# EasyEDA Pro project ProProject_Avaota Pi A_2024-03-25.epro, board 点位 (continued)
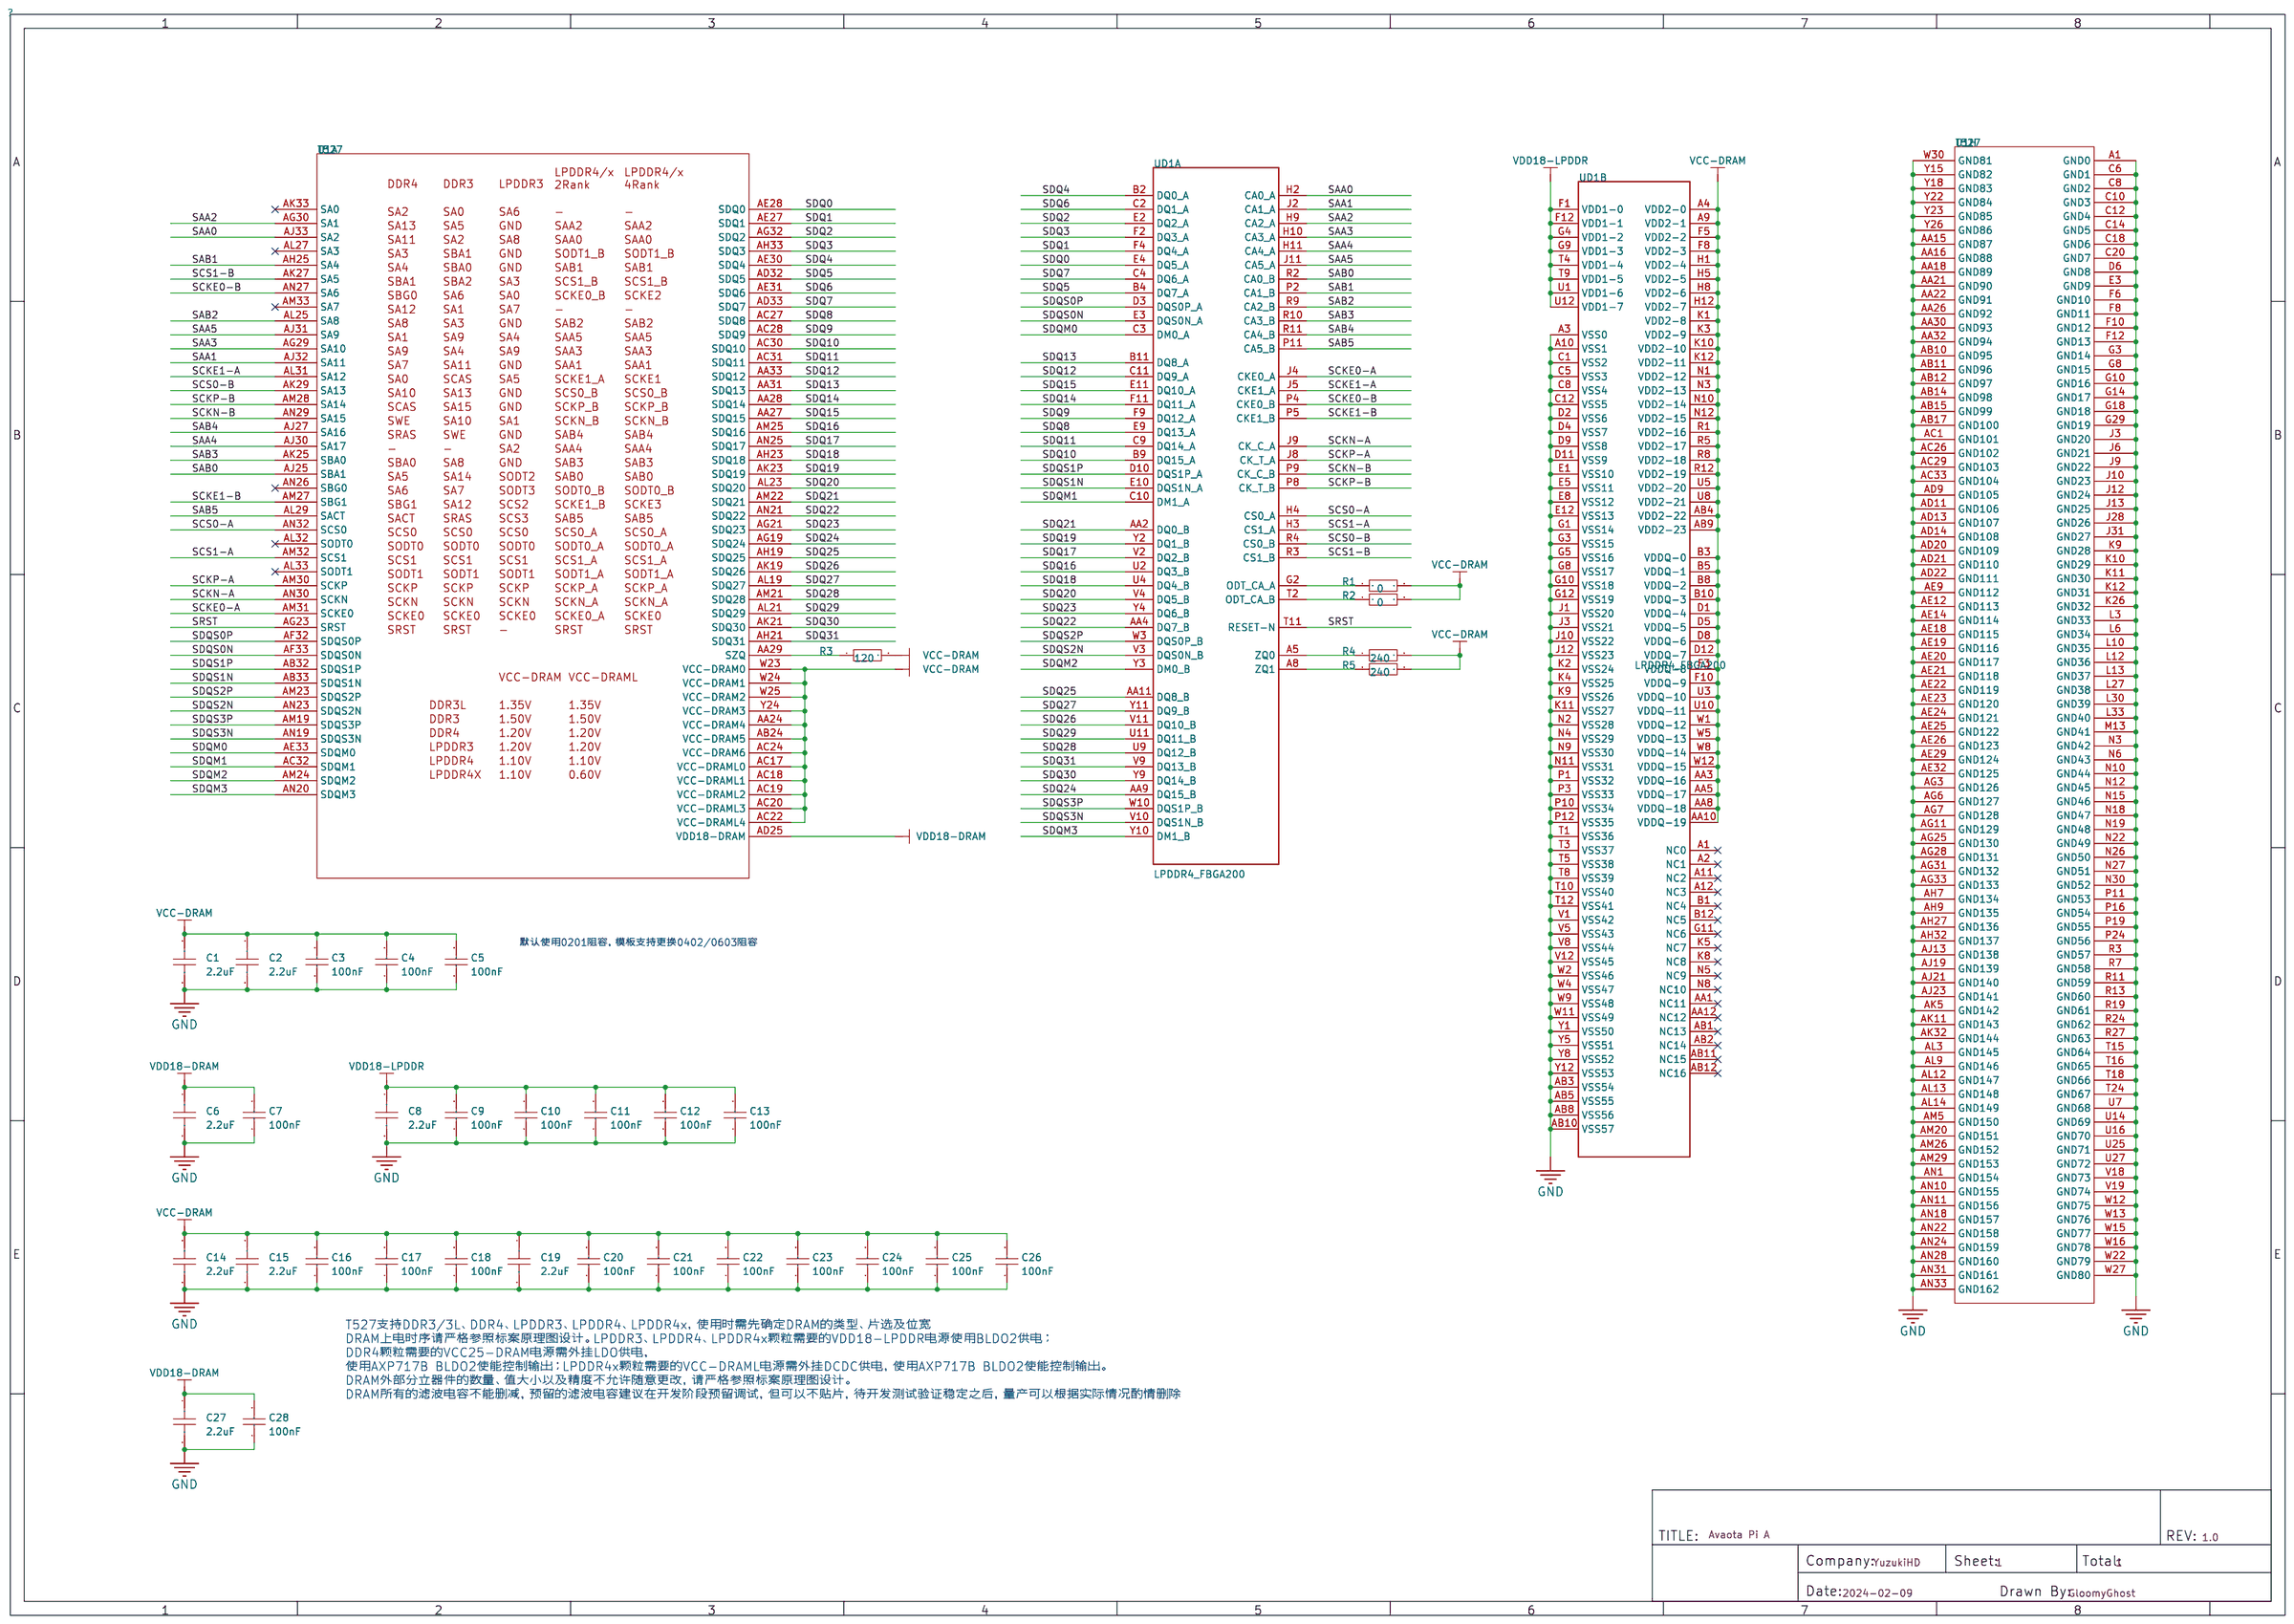
[diagram p0: schematic sheet]
## Routing (per net, layer and track width the routed paths; a pad name or vN(x,y) marks a point on that pad's centre or on a via; arc(x,y) is an arc through that point) (continued)
HTX0P: length 73.1
  Top Layer w0.076: 72.19,42.47 arc(71.77,42.75) 71.27,42.85 69.86,42.85 arc(69.84,42.85) 69.82,42.85 69.7,42.97 arc(69.62,43.03) 69.52,43.05 69.21,43.05 arc(69.06,43.07) 68.92,43.13
  Top Layer w0.102: USB1.7 44,9.93 44.2,9.93 45.43,11.16 45.43,19.9 45.58,20.05 D6.10 D6.1 45.47,21.43 45.47,22.1 v3(45.54,22.17) ; 72.2,42.47 72.56,42.11 arc(72.83,41.93) 73.15,41.86 74.15,41.84 arc(74.34,41.86) v3(74.52,41.94)
  内层4 w0.102: v3(74.52,41.94) 74.65,41.81 76.41,41.81 77.7,40.52 77.7,30.17 75.64,28.11 71.36,28.11 69.49,29.97 60.31,29.97 58.81,28.47 48.23,28.47 46.61,26.85 46.61,24.01 45.39,22.79 45.39,22.58 45.54,22.43 v3(45.54,22.17)
HTX1N: length 77.9
  Top Layer w0.076: 71.78,43.21 70.96,43.21 arc(70.76,43.24) 70.6,43.35 70.52,43.43 arc(70.41,43.51) 70.28,43.53 69.86,43.53 arc(69.72,43.51) 69.6,43.44 arc(69.48,43.39) 69.34,43.4 arc(69.24,43.45) 69.15,43.54 arc(69.05,43.61) 68.93,43.63
  Top Layer w0.102: 42.57,8.86 USB1.6 ; v3(46.46,22.15) 46.53,22.07 46.53,21.4 D5.5 D5.6 46.45,20.05 46.6,19.9 46.6,19.52 47.35,18.77 47.35,15.72 46.61,14.98 46.61,10.95 44.25,8.59 44.15,8.59 43.84,8.89 42.54,8.89 ; 71.79,43.19 72.42,43.19 arc(72.84,43.12) 73.2,42.9 arc(73.86,42.54) 74.6,42.47 arc(74.78,42.44) v3(74.93,42.34)
  内层4 w0.102: v3(74.93,42.34) 75.11,42.52 76.73,42.52 78.36,40.89 78.36,29.87 76,27.51 71.09,27.51 69.32,29.29 60.6,29.29 59.18,27.86 48.66,27.86 47.37,26.58 47.37,26.08 47.24,25.95 47.24,25.7 47.37,25.57 47.37,25.32 47.24,25.19 47.24,24.93 47.37,24.81 47.37,24.55 47.24,24.43 47.24,24.17 47.37,24.05 47.37,23.46 47.13,23.22 46.99,23.22 46.97,23.23 46.83,23.23 46.7,23.11 46.7,22.96 46.72,22.95 46.72,22.8 46.6,22.68 46.6,22.54 46.46,22.4 v3(46.46,22.15)
HTX1P: length 77.9
  Top Layer w0.076: 69.44,43.64 69.48,43.68 arc(69.51,43.7) 69.55,43.71 70.28,43.71 arc(70.48,43.67) 70.64,43.56 70.72,43.48 arc(70.83,43.41) 70.96,43.38 71.78,43.38 arc(71.83,43.39) 71.88,43.4
  Top Layer w0.102: v3(46.96,22.15) 46.84,22.02 46.84,21.43 D5.4 D5.7 46.95,20.05 46.8,19.9 46.8,19.61 47.55,18.86 47.55,15.64 46.81,14.9 46.81,10.86 44.37,8.42 44.37,8.18 43.93,7.73 USB1.4 ; 71.79,43.4 72.42,43.4 arc(72.91,43.31) 73.34,43.05 arc(73.92,42.73) 74.57,42.67 arc(74.77,42.73) v3(74.9,42.88)
  内层4 w0.102: v3(46.96,22.15) 46.96,22.37 46.8,22.54 46.8,22.59 47.57,23.36 47.57,26.49 48.74,27.66 59.27,27.66 60.69,29.08 69.22,29.08 70.99,27.3 76.08,27.3 78.54,29.76 78.54,41.05 76.84,42.75 75.03,42.75 v3(74.9,42.88)
HTX2N: length 82.9
  Top Layer w0.076: 68.44,44.14 68.57,44.01 arc(68.7,43.92) 68.86,43.89 70.56,43.89 arc(70.71,43.87) 70.83,43.78 70.84,43.78 arc(70.96,43.69) 71.11,43.66 71.82,43.66 ; 71.82,43.66 71.96,43.66 ; 71.82,43.66 arc(71.9,43.66) 71.97,43.65
  Top Layer w0.102: USB1.3 43.54,7 43.89,6.66 44.5,6.66 45.42,5.74 46.81,5.74 48.1,7.02 48.1,19.9 47.95,20.05 47.95,21.32 48.06,21.43 48.06,22.05 v3(47.96,22.15) ; 71.97,43.65 72.53,43.65 arc(73.46,43.65) 74.4,43.64 74.88,43.63 arc(75.13,43.57) v3(75.34,43.41)
  内层4 w0.102: v3(75.34,43.41) 75.49,43.56 77.07,43.56 79.17,41.46 79.17,29.39 76.56,26.77 70.77,26.77 69.2,28.35 60.8,28.35 59.63,27.18 49.09,27.18 48.12,26.2 48.12,22.56 47.96,22.4 v3(47.96,22.15)
HTX2P: length 82.9
  Top Layer w0.076: 68.94,44.14 68.98,44.1 arc(69.01,44.08) 69.05,44.07 70.64,44.07 arc(70.78,44.04) 70.9,43.96 70.96,43.9 arc(71.03,43.86) 71.11,43.84 71.9,43.84 ; 71.9,43.84 71.98,43.84 arc(71.94,43.84) 71.9,43.84
  Top Layer w0.102: USB1.1 43.54,6.1 43.89,6.45 44.42,6.45 45.33,5.54 46.9,5.54 48.3,6.94 48.3,19.9 48.45,20.05 D5.10 D5.1 48.34,21.43 48.34,22.01 v3(48.48,22.15) ; 72,43.85 72.53,43.85 arc(73.46,43.85) 74.4,43.84 74.88,43.83 arc(75.11,43.85) v3(75.34,43.92)
  内层4 w0.102: v3(48.48,22.15) 48.48,22.4 48.32,22.56 48.32,26.12 49.17,26.98 59.72,26.98 60.88,28.14 69.11,28.14 70.69,26.57 76.64,26.57 79.38,29.3 79.38,41.5 77.11,43.76 75.49,43.76 v3(75.34,43.92)
HTXCN: length 70.8
  Top Layer w0.076: 68.94,42.64 69.08,42.51 arc(69.2,42.42) 69.35,42.4 69.58,42.4 69.71,42.27 70.75,42.27 arc(70.84,42.27) 70.94,42.27 71.06,42.27 arc(71.2,42.24) 71.32,42.16
  Top Layer w0.102: 72.02,41.45 71.32,42.15 71.32,42.16 ; 72.02,41.45 72.03,41.44 ; 72.02,41.45 arc(73.07,40.74) 74.32,40.49 74.85,40.48 arc(75.06,40.43) v3(75.21,40.28) ; USB1.12 43.88,12.36 44.17,12.06 44.27,12.06 44.5,12.29 44.5,18.99 43.72,19.76 43.72,19.9 43.58,20.05 D6.6 D6.5 43.66,21.4 43.66,22.1 v3(43.59,22.17)
  内层4 w0.102: v3(43.59,22.17) 43.59,22.43 43.75,22.59 43.75,22.73 43.85,22.82 arc(43.9,22.94) 43.85,23.05 arc(43.8,23.16) 43.85,23.28 43.89,23.32 arc(44.01,23.37) 44.12,23.32 arc(44.23,23.27) 44.34,23.32 45.54,24.52 45.54,27.54 47.49,29.49 57.99,29.49 59.56,31.06 69.98,31.06 71.78,29.26 75.03,29.26 76.68,30.91 76.68,39.73 75.95,40.46 75.39,40.46 v3(75.21,40.28)
HTXCP: length 70.8
  Top Layer w0.076: 69.44,42.64 69.48,42.6 arc(69.52,42.58) 69.55,42.57 69.65,42.57 69.78,42.44 71.06,42.44 arc(71.27,42.41) 71.44,42.3
  Top Layer w0.102: v3(44.12,22.17) 44.02,22.07 44.02,21.38 D6.4 D6.7 44.08,20.05 43.93,19.9 43.93,19.85 44.7,19.07 44.7,12.12 44.22,11.63 44.22,11.48 43.97,11.23 42.57,11.23 USB1.10 ; 71.44,42.3 71.46,42.3 72.16,41.59 arc(73.15,40.93) 74.32,40.69 74.85,40.69 arc(75.05,40.73) v3(75.21,40.84)
  内层4 w0.102: v3(44.12,22.17) 44.12,22.43 43.95,22.59 43.95,22.64 45.72,24.41 45.72,27.43 47.57,29.29 58.07,29.29 59.65,30.86 69.85,30.86 71.65,29.06 75.12,29.06 76.89,30.83 76.89,39.81 76.03,40.67 75.39,40.67 v3(75.21,40.84)
IR-RX: length 130.7
  Top Layer w0.076: v1(54.94,48.67) 54.92,48.65 U14.AL16
  Top Layer w0.152: 98.12,16.61 98.12,15.59 97.69,15.16 94.89,15.16 94.08,15.98 v1(94.08,16.1) 94.1,16.12 R124.1
  内层2 w0.102: v1(44.81,57.71) 45.36,57.15 45.82,57.15 46.84,56.13 49.68,56.13 51.49,54.33 51.49,51.4 54.07,48.82 54.79,48.82 v1(54.94,48.67)
  内层4 w0.152: v1(43.59,64.87) 45.19,66.47 52.6,66.47 57.73,61.34 61.14,61.34 62.53,59.94 86.28,59.94 89.13,57.1 89.13,53.54 87.63,52.04 87.63,33.33 94.69,26.26 95.96,26.26 99.06,23.17 99.06,19.18 97.97,18.09 96.06,18.09 v1(94.08,16.1)
  Bottom Layer w0.102: v1(43.59,64.87) 43.84,64.62 43.84,63.98 44.04,63.78 44.04,60.02 45.21,58.85 45.21,58.12 v1(44.81,57.71)
LCD0-CLK: length 74.8
  Top Layer w0.076: 65.3,38.44 65.28,38.94 65.18,39.21 65.2,39.66 65.19,39.95 65.2,40.16 65.2,40.55 65.19,40.78 64.94,41.14
  Top Layer w0.102: 65.3,38.43 65.3,37.54 64.44,36.68 64.36,36.68 62.76,35.08 62.56,35.08 60.81,33.33 55.93,33.33 54.41,31.8 49.3,31.8 43.08,25.58 29.31,25.58 28.68,26.21 27.03,26.21 26.62,25.81 26.62,25.27 27.3,24.59 v3(27.3,23.75)
  Bottom Layer w0.127: FPC1.43 7.23,16.78 9.75,19.3 20.35,19.3 21.59,20.55 22.73,20.55 25.93,23.75 v3(27.3,23.75)
LCD0-D0: length 70
  Top Layer w0.127: v3(63.95,42.65) U14.N28
  内层2 w0.127: v3(34.82,34.65) 37.59,31.88 53.64,31.88 56.49,34.72 62.48,34.72 65.05,37.29 65.05,40.64 64.41,41.28 63.75,41.28 63.58,41.45 63.58,42.27 v3(63.95,42.65)
  Bottom Layer w0.127: FPC1.7 5.56,34.83 34.64,34.83 v3(34.82,34.65)
LCD0-D1: length 69.8
  Top Layer w0.127: U14.N29 v3(63.95,42.15)
  内层2 w0.127: v3(63.95,42.15) 64.05,42.15 65.43,40.77 65.43,37.16 62.61,34.34 56.77,34.34 53.92,31.5 37.39,31.5 v3(34.82,34.06)
  Bottom Layer w0.127: FPC1.8 11.52,34.28 11.74,34.49 34.39,34.49 v3(34.82,34.06)
LCD0-D2: length 70.6
  Top Layer w0.076: 67.94,40.65 68.19,40.4 68.19,39.88 68.63,39.45 68.63,38.25 v3(68.76,38.13)
  内层2 w0.127: v3(34.85,33.43) 37.19,31.09 54.15,31.09 57,33.93 64.01,33.93 68.2,38.13 v3(68.76,38.13)
  Bottom Layer w0.127: v3(34.85,33.43) 34.16,34.11 14.05,34.11 13.46,33.53 11.66,33.53 11.41,33.78 FPC1.9
LCD0-D3: length 70.6
  Top Layer w0.076: 67.94,40.15 67.94,39.8 68.4,39.34 v3(68.4,37.72)
  内层2 w0.127: v3(34.85,32.82) 37.06,30.61 54.23,30.61 57.18,33.55 64.24,33.55 v3(68.4,37.72)
  Bottom Layer w0.127: FPC1.10 11.17,33.28 11.96,32.49 13.23,32.49 14.15,33.4 14.15,33.43 14.45,33.73 33.93,33.73 v3(34.85,32.82)
LCD0-D4: length 70.7
  Top Layer w0.127: v3(67.92,41.65) U14.E30
  Bottom Layer w0.127: FPC1.11 10.86,32.78 11.58,32.06 13.59,32.06 14.86,33.33 33.66,33.33 35.89,31.09 42.39,31.09 45.24,33.93 57.23,33.93 61.01,37.72 61.01,39.55 62.43,40.97 64.59,40.97 64.9,40.67 67.32,40.67 67.56,40.91 67.56,41.49 67.72,41.65 v3(67.92,41.65)
LCD0-D5: length 70.6
  Top Layer w0.127: U14.E31 v3(67.92,41.15)
  Bottom Layer w0.127: v3(67.92,41.15) 67.92,40.75 67.46,40.28 64.77,40.28 64.47,40.59 62.66,40.59 61.49,39.42 61.49,37.59 57.38,33.48 45.44,33.48 42.6,30.63 35.69,30.63 33.38,32.94 15.09,32.94 13.77,31.62 11.38,31.62 10.73,32.28 FPC1.12
LCD0-D6: length 71.4
  Top Layer w0.076: v3(67.94,39.27) 67.69,39.52 67.69,40.41 67.44,40.65
  Bottom Layer w0.127: FPC1.13 10.49,31.78 11.02,31.24 14.07,31.24 15.37,32.54 33.12,32.54 35.48,30.18 42.85,30.18 45.72,33.05 57.56,33.05 61.9,37.39 61.9,39.22 62.89,40.21 64.34,40.21 64.62,39.93 67.28,39.93 v3(67.94,39.27)
LCD0-D7: length 70.6
  Top Layer w0.076: 67.44,40.15 67.44,39.06 v3(67.54,38.96)
  Bottom Layer w0.127: FPC1.14 10.35,31.28 10.79,30.84 14.33,30.84 15.6,32.11 32.94,32.11 35.31,29.74 43.03,29.74 45.92,32.64 57.78,32.64 62.36,37.21 62.36,39.14 63.02,39.8 64.11,39.8 64.31,39.6 66.9,39.6 v3(67.54,38.96)
LCD0-D8: length 67.3
  Top Layer w0.076: 63.94,41.15 64.19,40.9 64.19,40.02 64.08,39.9
  Top Layer w0.102: v3(63.91,39.42) 63.91,39.73 64.08,39.9
  Bottom Layer w0.127: v3(63.91,39.42) 63.2,39.42 62.79,39.01 62.79,37.03 58.01,32.26 46.1,32.26 43.21,29.36 35.15,29.36 32.84,31.67 15.82,31.67 14.6,30.45 10.54,30.45 10.22,30.78 FPC1.15
LCD0-D9: length 66.6
  Top Layer w0.076: 63.94,40.65 63.94,40.12 63.7,39.88
  Top Layer w0.102: v3(63.55,38.99) 63.55,39.73 63.7,39.88
  Bottom Layer w0.127: v3(63.55,38.99) 63.68,38.86 63.68,37.9 63.14,37.36 63.14,36.86 58.22,31.93 56.01,31.93 55.96,31.88 46.28,31.88 43.43,29.03 34.98,29.03 32.79,31.22 15.98,31.22 14.81,30.05 10.29,30.05 10.06,30.28 FPC1.16
LCD0-D10: length 69.4
  Top Layer w0.076: 67.19,38.74 67.19,40.4 66.94,40.65
  Top Layer w0.102: 67.19,38.74 67.51,38.42 67.51,36.83 66.95,36.27 66.12,36.27 65.15,35.31 65.15,34.9 64.8,34.54 v3(63.47,34.54)
  Inner5 w0.127: v3(32.31,30.81) 43.36,30.81 45.9,33.35 61.98,33.35 63.17,34.54 v3(63.47,34.54)
  Bottom Layer w0.127: v3(32.31,30.81) 32.28,30.84 16.18,30.84 14.99,29.64 10.11,29.64 9.97,29.78 FPC1.17
LCD0-D11: length 68.6
  Top Layer w0.076: 66.94,40.15 66.94,38.74
  Top Layer w0.102: 66.94,38.74 66.94,38.6 67.18,38.36 67.18,36.93 66.83,36.58 65.99,36.58 64.82,35.41 64.82,35.15 64.59,34.93 v3(63.93,34.93)
  Inner5 w0.127: v3(32.77,30.4) 43.59,30.4 46.1,32.92 62.36,32.92 63.93,34.49 v3(63.93,34.93)
  Bottom Layer w0.127: v3(32.77,30.4) 16.33,30.4 15.21,29.28 FPC1.18
LCD0-D12: length 70.7
  Top Layer w0.127: v3(66.92,41.65) U14.G30
  Inner5 w0.127: v3(33.17,30) 43.84,30 46.3,32.46 62.41,32.46 65.51,35.56 65.51,36.2 65.28,36.42 65.28,37.82 65.76,38.3 66.27,38.3 66.7,38.74 66.7,40.77 66.55,40.92 66.55,41.43 66.77,41.65 v3(66.92,41.65)
  Bottom Layer w0.127: FPC1.19 15.34,28.78 16.56,30 v3(33.17,30)
LCD0-D13: length 70.5
  Top Layer w0.127: U14.G31 v3(66.92,41.15)
  Inner5 w0.127: v3(66.92,41.15) 67.03,41.04 67.03,38.51 66.37,37.85 65.99,37.85 65.61,37.47 65.61,36.63 65.84,36.4 65.84,35.26 62.64,32.06 46.56,32.06 44.07,29.57 v3(33.55,29.57)
  Bottom Layer w0.127: v3(33.55,29.57) 16.76,29.57 15.48,28.28 FPC1.20
LCD0-D14: length 70.5
  Top Layer w0.076: 66.44,40.65 66.69,40.4 66.69,38.44 66.93,38.2 66.93,37.44 v3(66.83,37.34)
  Inner5 w0.127: v3(34.01,29.16) 44.3,29.16 46.76,31.62 62.86,31.62 66.12,34.87 66.12,36.63 65.94,36.8 65.94,37.19 66.22,37.47 66.7,37.47 v3(66.83,37.34)
  Bottom Layer w0.127: FPC1.21 15.66,27.78 17.04,29.16 v3(34.01,29.16)
LCD0-D15: length 69.7
  Top Layer w0.076: U14.G33 66.5,40.09 66.5,38.38 66.73,38.15 66.73,37.74 66.47,37.49 66.47,37.24 66.4,37.16 66.4,37.11 66.44,37.16
  Inner5 w0.127: v3(34.32,28.7) 44.42,28.7 46.91,31.19 63.12,31.19 66.4,34.47 v3(66.4,36.98)
  Bottom Layer w0.127: v3(34.32,28.7) 17.25,28.7 15.82,27.28 FPC1.22
LCD0-D16: length 66.9
  Top Layer w0.076: 62.94,41.15 63.19,40.9 63.19,40.05 63.2,40.04 63.27,39.76 63.28,39.31 63.21,39.11 63.22,38.83 v3(63.27,38.51)
  Top Layer w0.102: v3(63.27,38.51) 63.2,38.58
  内层4 w0.127: v3(28.88,28.22) 35.31,28.22 39.85,32.77 56.39,32.77 57.07,33.45 60.17,33.45 62,35.28 62,36.53 62.69,37.21 63.17,37.21 63.27,37.31 v3(63.27,38.51)
  Bottom Layer w0.127: FPC1.23 15.93,26.78 17.37,28.22 v3(28.88,28.22)
LCD0-D17: length 90
  Top Layer w0.076: 63.45,37.69 63.14,38 ; 63.14,38 63,38.18 62.94,38.35 62.94,39.75 63.02,39.83 63.02,39.83 63.03,40.06 63.02,40.29 63,40.39 62.94,40.6
  Top Layer w0.102: v3(63.58,36.88) 63.5,36.96 63.5,37.64 63.45,37.69
  内层4 w0.127: v3(29.26,27.81) 35.46,27.81 40.06,32.41 56.51,32.41 57.2,33.1 60.35,33.1 62.36,35.1 62.36,36.27 62.97,36.88 v3(63.58,36.88)
  Inner5 w0.127: 42.39,32.87 45.06,35.53 60.83,35.53 62.18,36.88 v3(63.58,36.88)
  Bottom Layer w0.127: v3(29.26,27.81) 17.65,27.81 16.12,26.28 FPC1.24
LCD0-D18: length 69.5
  Top Layer w0.102: v3(65.94,41.63) 65.94,41.63 U14.H31
  内层4 w0.127: v3(65.94,41.63) 65.94,38.99 65.2,38.25 65.2,37.41 60.5,32.72 57.4,32.72 56.72,32.03 40.21,32.03 35.59,27.41 v3(29.59,27.41)
  Bottom Layer w0.127: FPC1.25 16.3,25.78 17.93,27.41 v3(29.59,27.41)
LCD0-D19: length 75.2
  Top Layer w0.076: 65.94,40.65 65.97,40.68 66.09,40.68 66.17,40.6 66.17,39.39 66.31,39.24 66.31,38.75 66.12,38.56 66.12,38.38
  Top Layer w0.102: 66.12,38.38 66.12,37.19 64.36,35.43 v3(64.36,35.38)
  内层4 w0.127: v3(64.36,35.38) 66.73,35.38 v3(66.85,35.51)
  Inner5 w0.127: v3(29.95,27) 33.53,27 34.85,28.32 44.78,28.32 47.19,30.73 63.35,30.73 66.85,34.24 v3(66.85,35.51)
  Bottom Layer w0.127: FPC1.26 16.49,25.28 18.19,26.98 29.92,26.98 v3(29.95,27)
LCD0-D20: length 77
  Top Layer w0.102: U14.J29 65.92,42.63 v3(65.95,42.63)
  Inner5 w0.127: v3(65.95,42.63) 66.08,42.49 67.16,42.49 67.31,42.34 67.31,40.44 68.33,39.42 68.33,39.12 67.31,38.1 67.31,34.04 63.58,30.3 47.42,30.3 45.09,27.97 35.08,27.97 33.63,26.52 v3(30.33,26.52)
  Bottom Layer w0.127: v3(30.33,26.52) 18.47,26.52 16.73,24.78 FPC1.27
LCD0-D21: length 71.5
  Top Layer w0.102: U14.J30 65.92,42.13 v3(65.95,42.13)
  内层4 w0.127: v3(65.95,42.13) 66.32,41.76 66.32,38.84 65.53,38.05 65.53,37.24 60.68,32.39 57.66,32.39 56.92,31.65 40.46,31.65 35.84,27.03 31.67,27.03 v3(30.73,26.09)
  Bottom Layer w0.127: v3(30.73,26.09) 18.72,26.09 16.91,24.28 FPC1.28
LCD0-D22: length 70
  Top Layer w0.076: 65.69,39.26 65.69,40.26 65.44,40.51 65.44,40.65
  Top Layer w0.102: 65.69,39.26 65.84,39.11 65.84,37.34 64.67,36.17 64.57,36.17 62.94,34.54 62.76,34.54 61.04,32.82 56.34,32.82 54.71,31.19 49.61,31.19 43.36,24.94 28.93,24.94 28.27,25.6 v3(27.3,25.6)
  Bottom Layer w0.127: FPC1.29 17.17,23.78 19,25.6 v3(27.3,25.6)
LCD0-D23: length 71.1
  Top Layer w0.076: 65.58,38.97 65.46,39.2 65.49,39.48 65.48,39.99 65.44,40.14
  Top Layer w0.102: 65.58,38.97 65.58,37.43 64.57,36.42 64.49,36.42 62.86,34.8 62.64,34.8 60.91,33.07 56.13,33.07 54.56,31.5 49.45,31.5 43.21,25.25 29.13,25.25 28.4,25.98 27.15,25.98 26.92,25.76 26.92,25.43 27.2,25.15 v3(27.71,25.15)
  Bottom Layer w0.127: v3(27.71,25.15) 19.23,25.15 17.36,23.28 FPC1.30
LCD0-DE: length 74.2
  Top Layer w0.076: 65,40.59 64.94,40.65 65.04,40.36 65.04,40.17 65.02,39.95 65.04,39.66 65.04,39.65 65,39.05 65,38.46
  Top Layer w0.102: 65,38.46 65,37.83 v3(64.39,37.21)
  Inner5 w0.127: v3(64.39,37.21) 64.39,36.5 61.67,33.78 45.75,33.78 43.15,31.19 29.03,31.19 26.49,28.65 26.49,23.14 25.27,21.92 v3(23.44,21.92)
  Bottom Layer w0.127: v3(23.44,21.92) 20.9,21.92 19.43,20.45 9.12,20.45 6.95,18.28 FPC1.40
LCD0-HSYNC: length 84.3
  Top Layer w0.127: v3(64.95,42.65) U14.L28
  Inner5 w0.127: v3(64.95,42.65) 65.33,43.03 66.19,43.03 66.47,42.75 67.28,42.75 67.57,42.46 67.57,40.76 68.63,39.7 68.63,38.81 67.67,37.85 67.67,33.73 63.81,29.87 47.62,29.87 45.31,27.56 35.33,27.56 33.86,26.09 31.45,26.09 30.99,25.63 30.48,25.63 29.97,26.14 27.18,26.14 26.87,25.83 26.87,22.81 25.6,21.54 23.77,21.54 23.27,21.03 v3(22.45,21.03)
  Bottom Layer w0.127: FPC1.42 7.14,17.28 9.58,19.71 20.04,19.71 21.36,21.03 v3(22.45,21.03)
LCD0-PWM: length 77.5
  Top Layer w0.076: 64.8,39.25 64.8,39.26 64.79,39.57 64.86,40.16 64.77,40.45 64.72,40.52 64.69,40.62 64.69,40.9 64.44,41.15
  Top Layer w0.102: v3(64.24,37.77) 64.24,38.1 64.8,38.66 64.8,39.27
  内层2 w0.127: v3(28.12,24.66) 28.12,25.6 27.69,26.04 27.69,32.03 31.09,35.43 36.19,35.43 36.68,34.95 36.68,33.93 37.8,32.82 40.03,32.82 40.97,33.76 41.48,33.76 42.54,32.69 53.29,32.69 56.03,35.43 60.81,35.43 63.14,37.77 v3(64.24,37.77)
  Bottom Layer w0.127: v3(28.12,24.66) 19.41,24.66 17.58,22.83 7.19,22.83 6.63,22.28 FPC1.32
LCD0-RST: length 76.4
  Top Layer w0.076: 64.43,40.61 64.63,40.37 64.69,40.17 64.67,39.99 64.6,39.87 64.5,39.64 64.44,39.02
  Top Layer w0.102: 64.44,39.03 64.44,38.68 63.88,38.13 v3(63.88,37.36)
  内层2 w0.127: v3(63.88,37.36) 63.3,37.36 61.01,35.08 56.26,35.08 53.47,32.28 37.85,32.28 36.3,33.83 36.3,34.77 35.99,35.08 31.27,35.08 28.09,31.9 28.09,26.21 28.5,25.81 v3(28.5,24.23)
  Bottom Layer w0.127: v3(28.5,24.23) 19.68,24.23 17.86,22.4 7.42,22.4 6.79,21.78 FPC1.33
LCD0-VSYNC: length 80.8
  Top Layer w0.127: U14.L29 v3(64.95,42.15)
  内层2 w0.127: v3(22.94,21.46) 23.55,21.46 24.87,22.78 25.5,22.78 26.77,24.05 26.77,25.96 27.23,26.42 27.23,32.21 30.81,35.79 36.5,35.79 37.47,34.82 38.46,34.82 38.81,34.47 38.81,33.96 39.19,33.58 40.23,33.58 40.77,34.11 41.71,34.11 42.65,33.17 53.19,33.17 55.8,35.79 60.66,35.79 62.86,38 62.86,38.94 63.32,39.4 63.32,42.65 63.7,43.03 64.07,43.03 64.36,42.73 64.36,42.39 64.61,42.15 v3(64.95,42.15)
  Bottom Layer w0.127: v3(22.94,21.46) 21.13,21.46 19.76,20.09 9.32,20.09 7.01,17.78 FPC1.41
LEDC: length 123.6
  Top Layer w0.076: v1(2.62,18.97) 2.62,18.97 LED2.3 ; v1(81.18,48.59) 79.2,48.59 77.39,50.39 68.69,50.39 U14.C13
  内层2 w0.076: v1(2.62,18.97) 5.61,15.98 34.26,15.98 38.86,20.57 50.09,20.57 51.26,21.74 57.12,21.74 59.64,19.23 61.87,19.23 63.3,20.65 69.19,20.65 69.8,20.04 74.52,20.04 78.13,23.65 78.13,25.22 81.69,28.78 81.69,48.08 v1(81.18,48.59)
MCSI0-CKN: length 41.4
  Top Layer w0.102: U14.A10 69.39,51.7 69.39,51.84 69.57,52.02 70.77,52.02 71.2,52.45 v1(71.5,52.45)
  Bottom Layer w0.102: v1(71.5,52.45) 71.5,52.73 71.69,52.92 79.29,52.92 83.01,49.2 83.01,40.01 84.33,38.68 84.33,35.79 86.01,34.11 90.51,34.11 90.63,33.98 90.89,33.98 91.01,34.11 91.27,34.11 91.39,33.98 91.65,33.98 91.78,34.11 92.03,34.11 92.16,33.98 92.41,33.98 92.54,34.11 92.79,34.11 92.92,33.98 93.17,33.98 93.3,34.11 93.79,34.11 93.94,33.96 FPC2.12
MCSI0-CKP: length 41.3
  Top Layer w0.102: v1(71.07,52.91) 71.07,52.61 70.68,52.22 69.49,52.22 68.94,51.67 U14.B10
  Bottom Layer w0.102: FPC2.13 93.94,34.46 93.79,34.31 86.23,34.31 84.56,35.99 84.56,38.76 83.21,40.11 83.21,49.28 79.37,53.12 71.6,53.12 71.39,52.91 v1(71.07,52.91)
MCSI0-D0N: length 42.9
  Top Layer w0.076: U14.A12 70.97,50.65 71.37,51.05
  Top Layer w0.102: 71.37,51.05 71.55,51.23 79.12,51.23 79.73,50.62 79.73,49.25 v1(79.58,49.1)
  Bottom Layer w0.102: FPC2.6 94.54,31.01 93.95,31.01 93.85,31.12 93.44,31.12 93.31,30.99 93.06,30.99 92.93,31.12 92.68,31.12 92.55,30.99 92.3,30.99 92.17,31.12 91.92,31.12 91.79,30.99 91.53,30.99 91.41,31.12 91.15,31.12 91.03,30.99 90.77,30.99 90.65,31.12 84.55,31.12 82.12,33.55 82.12,37.21 80.11,39.22 80.11,48.29 79.58,48.82 v1(79.58,49.1)
MCSI0-D0P: length 43
  Top Layer w0.076: U14.B12 69.2,50.9 70.87,50.9 71.17,51.21
  Top Layer w0.102: 71.17,51.21 71.4,51.44 79.21,51.44 79.91,50.73 79.91,49.28 v1(80.11,49.07)
  Bottom Layer w0.102: FPC2.7 94.05,31.46 93.88,31.29 84.66,31.29 82.32,33.63 82.32,37.29 80.34,39.27 80.34,48.41 80.11,48.64 v1(80.11,49.07)
MCSI0-D1N: length 43.2
  Top Layer w0.076: 70.84,51.36 70.63,51.15 U14.B11
  Top Layer w0.102: v1(72.09,51.87) 71.35,51.87 70.84,51.36
  Bottom Layer w0.102: v1(72.09,51.87) 72.13,51.82 78.91,51.82 81.76,48.97 81.76,39.42 83.21,37.97 83.21,34.41 85,32.61 85.65,32.61 85.84,32.43 86.03,32.43 86.22,32.61 86.41,32.61 86.6,32.43 86.79,32.43 86.98,32.61 87.17,32.61 87.36,32.43 87.56,32.43 87.74,32.61 87.94,32.61 88.12,32.43 88.32,32.43 88.5,32.61 88.7,32.61 88.88,32.43 89.08,32.43 89.26,32.61 89.46,32.61 89.64,32.43 89.84,32.43 90.03,32.61 90.22,32.61 90.41,32.43 90.6,32.43 90.79,32.61 90.98,32.61 91.17,32.43 91.37,32.43 91.55,32.61 91.75,32.61 91.93,32.43 92.13,32.43 92.31,32.61 92.51,32.61 92.69,32.43 92.89,32.43 93.07,32.61 93.79,32.61 93.94,32.46 FPC2.9
MCSI0-D1P: length 43.3
  Top Layer w0.127: U14.C11 68.43,51.13 v1(68,51.13)
  Bottom Layer w0.102: FPC2.10 93.94,32.96 93.79,32.81 85.09,32.81 83.41,34.49 83.41,38.05 81.97,39.5 81.97,49.12 79.06,52.03 72.46,52.03 72.28,52.21 71.87,52.21 70.79,51.13 v1(68,51.13)
MCSI0-D2N: length 40.8
  Top Layer w0.102: v3(66.93,51.13) 66.96,51.13 U14.E12
  Inner5 w0.102: v3(66.93,51.13) 67.51,50.55 80.35,50.55 83.34,47.57 83.34,37.61 85.34,35.61 89.72,35.61 89.87,35.46 v1(90.12,35.46)
  Bottom Layer w0.102: v1(90.12,35.46) 90.27,35.61 93.79,35.61 93.94,35.46 FPC2.15
MCSI0-D2P: length 40.8
  Top Layer w0.102: v3(67.46,51.13) 67.94,50.65 U14.D12
  Inner5 w0.102: v1(90.12,35.97) 89.87,35.97 89.72,35.81 85.42,35.81 83.54,37.69 83.54,47.65 80.43,50.76 71.85,50.76 71.72,50.89 71.47,50.89 71.34,50.76 71.09,50.76 70.96,50.89 70.7,50.89 70.58,50.76 70.32,50.76 70.2,50.89 69.94,50.89 69.82,50.76 69.56,50.76 69.44,50.89 69.18,50.89 69.05,50.76 68.8,50.76 68.67,50.89 68.42,50.89 68.29,50.76 67.63,50.76 67.46,50.93 v3(67.46,51.13)
  Bottom Layer w0.102: v1(90.12,35.97) 90.27,35.81 93.79,35.81 93.94,35.96 FPC2.16
MCSI0-D3N: length 41.1
  Top Layer w0.102: v3(67.44,52.15) 67.44,51.65 U14.E10
  Inner5 w0.102: v1(93.47,36.93) 93.21,36.93 93.05,37.09 86.09,37.09 84.71,38.47 84.71,48.18 80.98,51.92 74.12,51.92 72.64,53.39 70.43,53.39 68.57,51.53 67.85,51.53 67.61,51.77 67.61,51.97 v3(67.44,52.15)
  Bottom Layer w0.102: v1(93.47,36.93) 93.72,36.93 93.88,37.09 94.34,37.09
MCSI0-D3P: length 41.1
  Top Layer w0.102: v3(67.94,52.15) 67.94,52.14 U14.D10
  Inner5 w0.102: v3(67.94,52.15) 67.79,51.99 67.79,51.84 67.93,51.71 68.46,51.71 68.53,51.77 68.53,51.97 68.7,52.14 68.9,52.14 69.07,52.31 69.07,52.51 69.24,52.68 69.44,52.68 70.35,53.59 72.73,53.59 74.18,52.15 81.03,52.15 84.91,48.27 84.91,38.56 86.17,37.3 93.05,37.3 93.21,37.46 v1(93.46,37.46)
  Bottom Layer w0.102: 94.34,37.3 93.88,37.3 93.72,37.46 v1(93.46,37.46)
MCSI0-MCLK: length 36.3
  Top Layer w0.152: v1(69.62,53.44) 69.44,53.62 U14.A6
  Bottom Layer w0.152: v1(69.62,53.44) 70.03,53.85 79.86,53.85 84.1,49.61 84.1,40.82 84.88,40.03 94.52,40.03 FPC2.24
MCSI0-PWDN: length 39
  Top Layer w0.076: 70.03,54.4 69.65,54.4 69.5,54.39 69.26,54.4 68.99,54.62
  Top Layer w0.102: v1(76.28,54.86) 75.82,54.41 70.03,54.41
  Bottom Layer w0.102: v1(76.28,54.86) 75.9,54.48 75.49,54.48 75.23,54.74 75.23,55.09 75.72,55.58 77.19,55.58 77.57,55.19 80.19,55.19 85.47,49.91 85.47,42.47 86.21,41.73 93.88,41.73 94.11,41.96 FPC2.28
MCSI0-RSTN: length 35.5
  Top Layer w0.102: v1(75.69,54.86) 75.47,54.65 U14.A4
  Bottom Layer w0.102: FPC2.27 86.05,41.46 85.19,42.32 85.19,49.78 80.11,54.86 77.44,54.86 77.01,55.3 76.12,55.3 v1(75.69,54.86)
MCSI0-SCK: length 39.7
  Top Layer w0.102: U14.E8 v3(67.44,53.13)
  Inner5 w0.102: v1(93.12,38.66) 93.09,38.66 91.95,39.8 89.61,39.8 85.88,43.54 85.88,48.69 81.61,52.96 74.9,52.96 73.41,54.46 69.95,54.46 68.22,52.73 67.69,52.73 67.44,52.98 v3(67.44,53.13)
  Bottom Layer w0.102: FPC2.21 93.31,38.46 v1(93.12,38.66)
  Bottom Layer w0.152: R127.2 68.49,53.49 67.67,53.49 67.44,53.27 v3(67.44,53.13)
MCSI0-SDA: length 38.1
  Top Layer w0.102: U14.D8 v3(67.94,53.13)
  Inner5 w0.102: v3(67.94,53.13) 68.19,53.13 69.8,54.74 73.61,54.74 75.08,53.26 81.74,53.26 86.16,48.84 86.16,43.69 89.79,40.06 92.15,40.06 92.96,39.24 v1(93.14,39.24)
  Bottom Layer w0.102: v1(93.14,39.24) 93.42,38.96 FPC2.22
  Bottom Layer w0.152: v3(67.94,53.13) 68.18,53.13 68.5,52.81 R128.2
MCSI0-USER: length 36.3
  Top Layer w0.076: U14.B5 69.19,53.9 69.75,53.9 70,54.15 70.31,54.15
  Top Layer w0.102: v1(76.89,54.81) 76.23,54.15 70.31,54.15
  Bottom Layer w0.102: v1(76.89,54.81) 77.04,54.81 77.29,54.56 80.04,54.56 84.89,49.71 84.89,42.22 85.98,41.12 93.95,41.12 94.11,40.96 FPC2.26
MICIN3N: length 22.1
  Top Layer w0.076: 56.94,56.14 56.94,56.25 56.76,56.43 56.76,56.99 56.6,57.15 v3(56.57,57.15)
  内层2 w0.127: v1(66.12,61.39) 65.99,61.27 64.72,61.27 62.18,58.73 57.47,58.73 56.66,57.91 56.66,57.64 56.57,57.55 v3(56.57,57.15)
  Bottom Layer w0.127: C241.1 69.89,67.75 70.07,67.57 70.07,66.79 70.41,66.45 70.41,64.64 68.66,62.89 67.79,62.89 66.29,61.39 v1(66.12,61.39)
MICIN3P: length 22.7
  Top Layer w0.076: 57.1,57.23 v3(57.1,57.22) 56.94,57.06 56.94,56.53 57.19,56.28 57.19,55.89 56.94,55.64
  内层2 w0.127: v1(66.12,60.76) 65.91,60.96 64.92,60.96 62.33,58.37 57.61,58.37 57.01,57.77 57.01,57.64 57.1,57.55 v3(57.1,57.22)
  Bottom Layer w0.127: v1(66.12,60.76) 67.92,62.56 68.65,62.56 70.64,64.55 70.64,66.55 70.3,66.88 70.3,67.57 70.48,67.75 C238.1
PE0: length 58
  Top Layer w0.102: U14.E6 67.94,54.15 v3(67.94,54.15)
  Inner5 w0.102: v3(67.94,54.15) 67.74,54.15 67.29,54.6 67.29,55.31 67.11,55.5 65.53,55.5 63.93,57.1 63.93,57.71 59.61,62.03 57.71,62.03 53.06,66.68 27.86,66.68 26.11,68.43 23.29,68.43 21.89,69.82 21.89,71.93 H1.12